# Altium schematic sheet Minion.SchDoc (part 3 of 4) (continued)
## Nets (continued)
U1_2.T28(CORE_VSS) U1_2.T30(CORE_VSS) U1_2.U1(CORE_VSS) U1_2.U3(CORE_VSS) U1_2.U5(CORE_VSS) U1_2.U7(CORE_VSS) U1_2.U9(CORE_VSS) U1_2.U11(CORE_VSS) U1_2.U13(CORE_VSS) U1_2.U15(CORE_VSS) U1_2.U17(CORE_VSS) U1_2.U19(CORE_VSS) U1_2.U21(CORE_VSS) U1_2.U23(CORE_VSS) U1_2.U25(CORE_VSS) U1_2.U27(CORE_VSS) U1_2.U29(CORE_VSS) U1_2.V2(CORE_VSS) U1_2.V4(CORE_VSS) U1_2.V6(CORE_VSS) U1_2.V8(CORE_VSS) U1_2.V10(CORE_VSS) U1_2.V12(CORE_VSS) U1_2.V14(CORE_VSS) U1_2.V16(CORE_VSS) U1_2.V18(CORE_VSS) U1_2.V20(CORE_VSS) U1_2.V22(CORE_VSS) U1_2.V24(CORE_VSS) U1_2.V26(CORE_VSS) U1_2.V28(CORE_VSS) U1_2.V30(CORE_VSS) U1_2.W1(CORE_VSS) U1_2.W3(CORE_VSS) U1_2.W5(CORE_VSS) U1_2.W7(CORE_VSS) U1_2.W9(CORE_VSS) U1_2.W11(CORE_VSS) U1_2.W13(CORE_VSS) U1_2.W15(CORE_VSS) U1_2.W17(CORE_VSS) U1_2.W19(CORE_VSS) U1_2.W21(CORE_VSS) U1_2.W23(CORE_VSS) U1_2.W25(CORE_VSS) U1_2.W27(CORE_VSS) U1_2.W29(CORE_VSS) U1_2.Y2(CORE_VSS) U1_2.Y4(CORE_VSS) U1_2.Y6(CORE_VSS) U1_2.Y8(CORE_VSS) U1_2.Y10(CORE_VSS) U1_2.Y12(CORE_VSS) U1_2.Y14(CORE_VSS) U1_2.Y16(CORE_VSS) U1_2.Y18(CORE_VSS) U1_2.Y20(CORE_VSS) U1_2.Y22(CORE_VSS) U1_2.Y24(CORE_VSS) U1_2.Y26(CORE_VSS) U1_2.Y28(CORE_VSS) U1_2.Y30(CORE_VSS) U1_3.A1(CORE_VSS) U1_3.A3(CORE_VSS) U1_3.A5(CORE_VSS) U1_3.A7(CORE_VSS) U1_3.A9(CORE_VSS) U1_3.A11(CORE_VSS) U1_3.A13(CORE_VSS) U1_3.A15(CORE_VSS) U1_3.A17(CORE_VSS) U1_3.A19(CORE_VSS) U1_3.A21(CORE_VSS) U1_3.A23(CORE_VSS) U1_3.A25(CORE_VSS) U1_3.A27(CORE_VSS) U1_3.A29(CORE_VSS) U1_3.AA1(CORE_VSS) U1_3.AA3(CORE_VSS) U1_3.AA5(CORE_VSS) U1_3.AA7(CORE_VSS) U1_3.AA9(CORE_VSS) U1_3.AA11(CORE_VSS) U1_3.AA13(CORE_VSS) U1_3.AA15(CORE_VSS) U1_3.AA17(CORE_VSS) U1_3.AA19(CORE_VSS) U1_3.AA21(CORE_VSS) U1_3.AA23(CORE_VSS) U1_3.AA25(CORE_VSS) U1_3.AA27(CORE_VSS) U1_3.AA29(CORE_VSS) U1_3.AB2(CORE_VSS) U1_3.AB4(CORE_VSS) U1_3.AB6(CORE_VSS) U1_3.AB8(CORE_VSS) U1_3.AB10(CORE_VSS) U1_3.AB12(CORE_VSS) U1_3.AB14(CORE_VSS) U1_3.AB16(CORE_VSS) U1_3.AB18(CORE_VSS) U1_3.AB20(CORE_VSS) U1_3.AB22(CORE_VSS) U1_3.AB24(CORE_VSS) U1_3.AB26(CORE_VSS) U1_3.AB28(CORE_VSS) U1_3.AB30(CORE_VSS) U1_3.AC1(CORE_VSS) U1_3.AC3(CORE_VSS) U1_3.AC5(CORE_VSS) U1_3.AC7(CORE_VSS) U1_3.AC9(CORE_VSS) U1_3.AC11(CORE_VSS) U1_3.AC13(CORE_VSS) U1_3.AC15(CORE_VSS) U1_3.AC17(CORE_VSS) U1_3.AC19(CORE_VSS) U1_3.AC21(CORE_VSS) U1_3.AC23(CORE_VSS) U1_3.AC25(CORE_VSS) U1_3.AC27(CORE_VSS) U1_3.AC29(CORE_VSS) U1_3.AD2(CORE_VSS) U1_3.AD4(CORE_VSS) U1_3.AD6(CORE_VSS) U1_3.AD8(CORE_VSS) U1_3.AD10(CORE_VSS) U1_3.AD12(CORE_VSS) U1_3.AD14(CORE_VSS) U1_3.AD16(CORE_VSS) U1_3.AD18(CORE_VSS) U1_3.AD20(CORE_VSS) U1_3.AD22(CORE_VSS) U1_3.AD24(CORE_VSS) U1_3.AD26(CORE_VSS) U1_3.AD28(CORE_VSS) U1_3.AD30(CORE_VSS) U1_3.AE1(CORE_VSS) U1_3.AE3(CORE_VSS) U1_3.AE5(CORE_VSS) U1_3.AE7(CORE_VSS) U1_3.AE9(CORE_VSS) U1_3.AE11(CORE_VSS) U1_3.AE13(CORE_VSS) U1_3.AE15(CORE_VSS) U1_3.AE17(CORE_VSS) U1_3.AE19(CORE_VSS) U1_3.AE21(CORE_VSS) U1_3.AE23(CORE_VSS) U1_3.AE25(CORE_VSS) U1_3.AE27(CORE_VSS) U1_3.AE29(CORE_VSS) U1_3.AF2(CORE_VSS) U1_3.AF4(CORE_VSS) U1_3.AF6(CORE_VSS) U1_3.AF8(CORE_VSS) U1_3.AF10(CORE_VSS) U1_3.AF12(CORE_VSS) U1_3.AF14(CORE_VSS) U1_3.AF16(CORE_VSS) U1_3.AF18(CORE_VSS) U1_3.AF20(CORE_VSS) U1_3.AF22(CORE_VSS) U1_3.AF24(CORE_VSS) U1_3.AF26(CORE_VSS) U1_3.AF28(CORE_VSS) U1_3.AF30(CORE_VSS) U1_3.AG1(CORE_VSS) U1_3.AG3(CORE_VSS) U1_3.AG5(CORE_VSS) U1_3.AG7(CORE_VSS) U1_3.AG9(CORE_VSS) U1_3.AG11(CORE_VSS) U1_3.AG13(CORE_VSS) U1_3.AG15(CORE_VSS) U1_3.AG17(CORE_VSS) U1_3.AG19(CORE_VSS) U1_3.AG21(CORE_VSS) U1_3.AG23(CORE_VSS) U1_3.AG25(CORE_VSS) U1_3.AG27(CORE_VSS) U1_3.AG29(CORE_VSS) U1_3.AH2(CORE_VSS) U1_3.AH4(CORE_VSS) U1_3.AH6(CORE_VSS) U1_3.AH8(CORE_VSS) U1_3.AH10(CORE_VSS) U1_3.AH12(CORE_VSS) U1_3.AH14(CORE_VSS) U1_3.AH16(CORE_VSS) U1_3.AH18(CORE_VSS) U1_3.AH20(CORE_VSS) U1_3.AH22(CORE_VSS) U1_3.AH24(CORE_VSS) U1_3.AH26(CORE_VSS) U1_3.AH28(CORE_VSS) U1_3.AH30(CORE_VSS) U1_3.AJ1(CORE_VSS) U1_3.AJ3(CORE_VSS) U1_3.AJ4(IO_VSS) U1_3.AJ6(IO_VSS) U1_3.AJ9(CORE_VSS) U1_3.AJ11(IO_VSS) U1_3.AJ17(CORE_VSS) U1_3.AJ20(CHIP_ADDR0) U1_3.AJ21(CHIP_ADDR2) U1_3.AJ22(CHIP_ADDR4) U1_3.AJ26(SPI_MODE) U1_3.AJ27(CORE_VSS) U1_3.AJ29(CORE_VSS) U1_3.AK2(CORE_VSS) U1_3.AK11(TD_AVSS18) U1_3.AK12(POR_AGND18) U1_3.AK14(CORE_VSS) U1_3.AK15(PLL_AVSS) U1_3.AK16(PLL_AVSS2) U1_3.AK17(IO_VSS) U1_3.AK20(CORE_VSS) U1_3.AK22(CHIP_ADDR3) U1_3.AK23(IO_VSS) U1_3.AK30(CORE_VSS) U1_3.B2(CORE_VSS) U1_3.B4(CORE_VSS) U1_3.B6(CORE_VSS) U1_3.B8(CORE_VSS) U1_3.B10(CORE_VSS) U1_3.B12(CORE_VSS) U1_3.B14(CORE_VSS) U1_3.B16(CORE_VSS) U1_3.B18(CORE_VSS) U1_3.B20(CORE_VSS) U1_3.B22(CORE_VSS) U1_3.B24(CORE_VSS) U1_3.B26(CORE_VSS) U1_3.B28(CORE_VSS) U1_3.B30(CORE_VSS) U1_3.C1(CORE_VSS) U1_3.C3(CORE_VSS) U1_3.C5(CORE_VSS) U1_3.C7(CORE_VSS) U1_3.C9(CORE_VSS) U1_3.C11(CORE_VSS) U1_3.C13(CORE_VSS) U1_3.C15(CORE_VSS) U1_3.C17(CORE_VSS) U1_3.C19(CORE_VSS) U1_3.C21(CORE_VSS) U1_3.C23(CORE_VSS) U1_3.C25(CORE_VSS) U1_3.C27(CORE_VSS) U1_3.C29(CORE_VSS) U1_3.D2(CORE_VSS) U1_3.D4(CORE_VSS) U1_3.D6(CORE_VSS) U1_3.D8(CORE_VSS) U1_3.D10(CORE_VSS) U1_3.D12(CORE_VSS) U1_3.D14(CORE_VSS) U1_3.D16(CORE_VSS) U1_3.D18(CORE_VSS) U1_3.D20(CORE_VSS) U1_3.D22(CORE_VSS) U1_3.D24(CORE_VSS) U1_3.D26(CORE_VSS) U1_3.D28(CORE_VSS) U1_3.D30(CORE_VSS) U1_3.E1(CORE_VSS) U1_3.E3(CORE_VSS) U1_3.E5(CORE_VSS) U1_3.E7(CORE_VSS) U1_3.E9(CORE_VSS) U1_3.E11(CORE_VSS) U1_3.E13(CORE_VSS) U1_3.E15(CORE_VSS) U1_3.E17(CORE_VSS) U1_3.E19(CORE_VSS) U1_3.E21(CORE_VSS) U1_3.E23(CORE_VSS) U1_3.E25(CORE_VSS) U1_3.E27(CORE_VSS) U1_3.E29(CORE_VSS) U1_3.F2(CORE_VSS) U1_3.F4(CORE_VSS) U1_3.F6(CORE_VSS) U1_3.F8(CORE_VSS) U1_3.F10(CORE_VSS) U1_3.F12(CORE_VSS) U1_3.F14(CORE_VSS) U1_3.F16(CORE_VSS) U1_3.F18(CORE_VSS) U1_3.F20(CORE_VSS) U1_3.F22(CORE_VSS) U1_3.F24(CORE_VSS) U1_3.F26(CORE_VSS) U1_3.F28(CORE_VSS) U1_3.F30(CORE_VSS) U1_3.G1(CORE_VSS) U1_3.G3(CORE_VSS) U1_3.G5(CORE_VSS) U1_3.G7(CORE_VSS) U1_3.G9(CORE_VSS) U1_3.G11(CORE_VSS) U1_3.G13(CORE_VSS) U1_3.G15(CORE_VSS) U1_3.G17(CORE_VSS) U1_3.G19(CORE_VSS) U1_3.G21(CORE_VSS) U1_3.G23(CORE_VSS) U1_3.G25(CORE_VSS) U1_3.G27(CORE_VSS) U1_3.G29(CORE_VSS) U1_3.H2(CORE_VSS) U1_3.H4(CORE_VSS) U1_3.H6(CORE_VSS) U1_3.H8(CORE_VSS) U1_3.H10(CORE_VSS) U1_3.H12(CORE_VSS) U1_3.H14(CORE_VSS) U1_3.H16(CORE_VSS) U1_3.H18(CORE_VSS) U1_3.H20(CORE_VSS) U1_3.H22(CORE_VSS) U1_3.H24(CORE_VSS) U1_3.H26(CORE_VSS) U1_3.H28(CORE_VSS) U1_3.H30(CORE_VSS) U1_3.J1(CORE_VSS) U1_3.J3(CORE_VSS) U1_3.J5(CORE_VSS) U1_3.J7(CORE_VSS) U1_3.J9(CORE_VSS) U1_3.J11(CORE_VSS) U1_3.J13(CORE_VSS) U1_3.J15(CORE_VSS) U1_3.J17(CORE_VSS) U1_3.J19(CORE_VSS) U1_3.J21(CORE_VSS) U1_3.J23(CORE_VSS) U1_3.J25(CORE_VSS) U1_3.J27(CORE_VSS) U1_3.J29(CORE_VSS) U1_3.K2(CORE_VSS) U1_3.K4(CORE_VSS) U1_3.K6(CORE_VSS) U1_3.K8(CORE_VSS) U1_3.K10(CORE_VSS) U1_3.K12(CORE_VSS) U1_3.K14(CORE_VSS) U1_3.K16(CORE_VSS) U1_3.K18(CORE_VSS) U1_3.K20(CORE_VSS) U1_3.K22(CORE_VSS) U1_3.K24(CORE_VSS) U1_3.K26(CORE_VSS) U1_3.K28(CORE_VSS) U1_3.K30(CORE_VSS) U1_3.L1(CORE_VSS) U1_3.L3(CORE_VSS) U1_3.L5(CORE_VSS) U1_3.L7(CORE_VSS) U1_3.L9(CORE_VSS) U1_3.L11(CORE_VSS) U1_3.L13(CORE_VSS) U1_3.L15(CORE_VSS) U1_3.L17(CORE_VSS) U1_3.L19(CORE_VSS) U1_3.L21(CORE_VSS) U1_3.L23(CORE_VSS) U1_3.L25(CORE_VSS) U1_3.L27(CORE_VSS) U1_3.L29(CORE_VSS) U1_3.M2(CORE_VSS) U1_3.M4(CORE_VSS) U1_3.M6(CORE_VSS) U1_3.M8(CORE_VSS) U1_3.M10(CORE_VSS) U1_3.M12(CORE_VSS) U1_3.M14(CORE_VSS) U1_3.M16(CORE_VSS) U1_3.M18(CORE_VSS) U1_3.M20(CORE_VSS) U1_3.M22(CORE_VSS) U1_3.M24(CORE_VSS) U1_3.M26(CORE_VSS) U1_3.M28(CORE_VSS) U1_3.M30(CORE_VSS) U1_3.N1(CORE_VSS) U1_3.N3(CORE_VSS) U1_3.N5(CORE_VSS) U1_3.N7(CORE_VSS) U1_3.N9(CORE_VSS) U1_3.N11(CORE_VSS) U1_3.N13(CORE_VSS) U1_3.N15(CORE_VSS) U1_3.N17(CORE_VSS) U1_3.N19(CORE_VSS) U1_3.N21(CORE_VSS) U1_3.N23(CORE_VSS) U1_3.N25(CORE_VSS) U1_3.N27(CORE_VSS) U1_3.N29(CORE_VSS) U1_3.P2(CORE_VSS) U1_3.P4(CORE_VSS) U1_3.P6(CORE_VSS) U1_3.P8(CORE_VSS) U1_3.P10(CORE_VSS) U1_3.P12(CORE_VSS) U1_3.P14(CORE_VSS) U1_3.P16(CORE_VSS) U1_3.P18(CORE_VSS) U1_3.P20(CORE_VSS) U1_3.P22(CORE_VSS) U1_3.P24(CORE_VSS) U1_3.P26(CORE_VSS) U1_3.P28(CORE_VSS) U1_3.P30(CORE_VSS) U1_3.R1(CORE_VSS) U1_3.R3(CORE_VSS) U1_3.R5(CORE_VSS) U1_3.R7(CORE_VSS) U1_3.R9(CORE_VSS) U1_3.R11(CORE_VSS) U1_3.R13(CORE_VSS) U1_3.R15(CORE_VSS) U1_3.R17(CORE_VSS) U1_3.R19(CORE_VSS) U1_3.R21(CORE_VSS) U1_3.R23(CORE_VSS) U1_3.R25(CORE_VSS) U1_3.R27(CORE_VSS) U1_3.R29(CORE_VSS) U1_3.T2(CORE_VSS) U1_3.T4(CORE_VSS) U1_3.T6(CORE_VSS) U1_3.T8(CORE_VSS) U1_3.T10(CORE_VSS) U1_3.T12(CORE_VSS) U1_3.T14(CORE_VSS) U1_3.T16(CORE_VSS) U1_3.T18(CORE_VSS) U1_3.T20(CORE_VSS) U1_3.T22(CORE_VSS) U1_3.T24(CORE_VSS) U1_3.T26(CORE_VSS) U1_3.T28(CORE_VSS) U1_3.T30(CORE_VSS) U1_3.U1(CORE_VSS) U1_3.U3(CORE_VSS) U1_3.U5(CORE_VSS) U1_3.U7(CORE_VSS) U1_3.U9(CORE_VSS) U1_3.U11(CORE_VSS) U1_3.U13(CORE_VSS) U1_3.U15(CORE_VSS) U1_3.U17(CORE_VSS) U1_3.U19(CORE_VSS) U1_3.U21(CORE_VSS) U1_3.U23(CORE_VSS) U1_3.U25(CORE_VSS) U1_3.U27(CORE_VSS) U1_3.U29(CORE_VSS) U1_3.V2(CORE_VSS) U1_3.V4(CORE_VSS) U1_3.V6(CORE_VSS) U1_3.V8(CORE_VSS) U1_3.V10(CORE_VSS) U1_3.V12(CORE_VSS) U1_3.V14(CORE_VSS) U1_3.V16(CORE_VSS) U1_3.V18(CORE_VSS) U1_3.V20(CORE_VSS) U1_3.V22(CORE_VSS) U1_3.V24(CORE_VSS) U1_3.V26(CORE_VSS) U1_3.V28(CORE_VSS) U1_3.V30(CORE_VSS) U1_3.W1(CORE_VSS) U1_3.W3(CORE_VSS) U1_3.W5(CORE_VSS) U1_3.W7(CORE_VSS) U1_3.W9(CORE_VSS) U1_3.W11(CORE_VSS) U1_3.W13(CORE_VSS) U1_3.W15(CORE_VSS) U1_3.W17(CORE_VSS) U1_3.W19(CORE_VSS) U1_3.W21(CORE_VSS) U1_3.W23(CORE_VSS) U1_3.W25(CORE_VSS) U1_3.W27(CORE_VSS) U1_3.W29(CORE_VSS) U1_3.Y2(CORE_VSS) U1_3.Y4(CORE_VSS) U1_3.Y6(CORE_VSS) U1_3.Y8(CORE_VSS) U1_3.Y10(CORE_VSS) U1_3.Y12(CORE_VSS) U1_3.Y14(CORE_VSS) U1_3.Y16(CORE_VSS) U1_3.Y18(CORE_VSS) U1_3.Y20(CORE_VSS) U1_3.Y22(CORE_VSS) U1_3.Y24(CORE_VSS) U1_3.Y26(CORE_VSS) U1_3.Y28(CORE_VSS) U1_3.Y30(CORE_VSS) U1_4.A1(CORE_VSS) U1_4.A3(CORE_VSS) U1_4.A5(CORE_VSS) U1_4.A7(CORE_VSS) U1_4.A9(CORE_VSS) U1_4.A11(CORE_VSS) U1_4.A13(CORE_VSS) U1_4.A15(CORE_VSS) U1_4.A17(CORE_VSS) U1_4.A19(CORE_VSS) U1_4.A21(CORE_VSS) U1_4.A23(CORE_VSS) U1_4.A25(CORE_VSS) U1_4.A27(CORE_VSS) U1_4.A29(CORE_VSS) U1_4.AA1(CORE_VSS) U1_4.AA3(CORE_VSS) U1_4.AA5(CORE_VSS) U1_4.AA7(CORE_VSS) U1_4.AA9(CORE_VSS) U1_4.AA11(CORE_VSS) U1_4.AA13(CORE_VSS) U1_4.AA15(CORE_VSS) U1_4.AA17(CORE_VSS) U1_4.AA19(CORE_VSS) U1_4.AA21(CORE_VSS) U1_4.AA23(CORE_VSS) U1_4.AA25(CORE_VSS) U1_4.AA27(CORE_VSS) U1_4.AA29(CORE_VSS) U1_4.AB2(CORE_VSS) U1_4.AB4(CORE_VSS) U1_4.AB6(CORE_VSS) U1_4.AB8(CORE_VSS) U1_4.AB10(CORE_VSS) U1_4.AB12(CORE_VSS) U1_4.AB14(CORE_VSS) U1_4.AB16(CORE_VSS) U1_4.AB18(CORE_VSS) U1_4.AB20(CORE_VSS) U1_4.AB22(CORE_VSS) U1_4.AB24(CORE_VSS) U1_4.AB26(CORE_VSS) U1_4.AB28(CORE_VSS) U1_4.AB30(CORE_VSS) U1_4.AC1(CORE_VSS) U1_4.AC3(CORE_VSS) U1_4.AC5(CORE_VSS) U1_4.AC7(CORE_VSS) U1_4.AC9(CORE_VSS) U1_4.AC11(CORE_VSS) U1_4.AC13(CORE_VSS) U1_4.AC15(CORE_VSS) U1_4.AC17(CORE_VSS) U1_4.AC19(CORE_VSS) U1_4.AC21(CORE_VSS) U1_4.AC23(CORE_VSS) U1_4.AC25(CORE_VSS) U1_4.AC27(CORE_VSS) U1_4.AC29(CORE_VSS) U1_4.AD2(CORE_VSS) U1_4.AD4(CORE_VSS) U1_4.AD6(CORE_VSS) U1_4.AD8(CORE_VSS) U1_4.AD10(CORE_VSS) U1_4.AD12(CORE_VSS) U1_4.AD14(CORE_VSS) U1_4.AD16(CORE_VSS) U1_4.AD18(CORE_VSS) U1_4.AD20(CORE_VSS) U1_4.AD22(CORE_VSS) U1_4.AD24(CORE_VSS) U1_4.AD26(CORE_VSS) U1_4.AD28(CORE_VSS) U1_4.AD30(CORE_VSS) U1_4.AE1(CORE_VSS) U1_4.AE3(CORE_VSS) U1_4.AE5(CORE_VSS) U1_4.AE7(CORE_VSS) U1_4.AE9(CORE_VSS) U1_4.AE11(CORE_VSS) U1_4.AE13(CORE_VSS) U1_4.AE15(CORE_VSS) U1_4.AE17(CORE_VSS) U1_4.AE19(CORE_VSS) U1_4.AE21(CORE_VSS) U1_4.AE23(CORE_VSS) U1_4.AE25(CORE_VSS) U1_4.AE27(CORE_VSS) U1_4.AE29(CORE_VSS) U1_4.AF2(CORE_VSS) U1_4.AF4(CORE_VSS) U1_4.AF6(CORE_VSS) U1_4.AF8(CORE_VSS) U1_4.AF10(CORE_VSS) U1_4.AF12(CORE_VSS) U1_4.AF14(CORE_VSS) U1_4.AF16(CORE_VSS) U1_4.AF18(CORE_VSS) U1_4.AF20(CORE_VSS) U1_4.AF22(CORE_VSS) U1_4.AF24(CORE_VSS) U1_4.AF26(CORE_VSS) U1_4.AF28(CORE_VSS) U1_4.AF30(CORE_VSS) U1_4.AG1(CORE_VSS) U1_4.AG3(CORE_VSS) U1_4.AG5(CORE_VSS) U1_4.AG7(CORE_VSS) U1_4.AG9(CORE_VSS) U1_4.AG11(CORE_VSS) U1_4.AG13(CORE_VSS) U1_4.AG15(CORE_VSS) U1_4.AG17(CORE_VSS) U1_4.AG19(CORE_VSS) U1_4.AG21(CORE_VSS) U1_4.AG23(CORE_VSS) U1_4.AG25(CORE_VSS) U1_4.AG27(CORE_VSS) U1_4.AG29(CORE_VSS) U1_4.AH2(CORE_VSS) U1_4.AH4(CORE_VSS) U1_4.AH6(CORE_VSS) U1_4.AH8(CORE_VSS) U1_4.AH10(CORE_VSS) U1_4.AH12(CORE_VSS) U1_4.AH14(CORE_VSS) U1_4.AH16(CORE_VSS) U1_4.AH18(CORE_VSS) U1_4.AH20(CORE_VSS) U1_4.AH22(CORE_VSS) U1_4.AH24(CORE_VSS) U1_4.AH26(CORE_VSS) U1_4.AH28(CORE_VSS) U1_4.AH30(CORE_VSS) U1_4.AJ1(CORE_VSS) U1_4.AJ3(CORE_VSS) U1_4.AJ4(IO_VSS) U1_4.AJ6(IO_VSS) U1_4.AJ9(CORE_VSS) U1_4.AJ11(IO_VSS) U1_4.AJ17(CORE_VSS) U1_4.AJ21(CHIP_ADDR2) U1_4.AJ22(CHIP_ADDR4) U1_4.AJ26(SPI_MODE) U1_4.AJ27(CORE_VSS) U1_4.AJ29(CORE_VSS) U1_4.AK2(CORE_VSS) U1_4.AK11(TD_AVSS18) U1_4.AK12(POR_AGND18) U1_4.AK14(CORE_VSS) U1_4.AK15(PLL_AVSS) U1_4.AK16(PLL_AVSS2) U1_4.AK17(IO_VSS) U1_4.AK20(CORE_VSS) U1_4.AK22(CHIP_ADDR3) U1_4.AK23(IO_VSS) U1_4.AK30(CORE_VSS) U1_4.B2(CORE_VSS) U1_4.B4(CORE_VSS) U1_4.B6(CORE_VSS) U1_4.B8(CORE_VSS) U1_4.B10(CORE_VSS) U1_4.B12(CORE_VSS) U1_4.B14(CORE_VSS) U1_4.B16(CORE_VSS) U1_4.B18(CORE_VSS) U1_4.B20(CORE_VSS) U1_4.B22(CORE_VSS) U1_4.B24(CORE_VSS) U1_4.B26(CORE_VSS) U1_4.B28(CORE_VSS) U1_4.B30(CORE_VSS) U1_4.C1(CORE_VSS) U1_4.C3(CORE_VSS) U1_4.C5(CORE_VSS) U1_4.C7(CORE_VSS) U1_4.C9(CORE_VSS) U1_4.C11(CORE_VSS) U1_4.C13(CORE_VSS) U1_4.C15(CORE_VSS) U1_4.C17(CORE_VSS) U1_4.C19(CORE_VSS) U1_4.C21(CORE_VSS) U1_4.C23(CORE_VSS) U1_4.C25(CORE_VSS) U1_4.C27(CORE_VSS) U1_4.C29(CORE_VSS) U1_4.D2(CORE_VSS) U1_4.D4(CORE_VSS) U1_4.D6(CORE_VSS) U1_4.D8(CORE_VSS) U1_4.D10(CORE_VSS) U1_4.D12(CORE_VSS) U1_4.D14(CORE_VSS) U1_4.D16(CORE_VSS) U1_4.D18(CORE_VSS) U1_4.D20(CORE_VSS) U1_4.D22(CORE_VSS) U1_4.D24(CORE_VSS) U1_4.D26(CORE_VSS) U1_4.D28(CORE_VSS) U1_4.D30(CORE_VSS) U1_4.E1(CORE_VSS) U1_4.E3(CORE_VSS) U1_4.E5(CORE_VSS) U1_4.E7(CORE_VSS) U1_4.E9(CORE_VSS) U1_4.E11(CORE_VSS) U1_4.E13(CORE_VSS) U1_4.E15(CORE_VSS) U1_4.E17(CORE_VSS) U1_4.E19(CORE_VSS) U1_4.E21(CORE_VSS) U1_4.E23(CORE_VSS) U1_4.E25(CORE_VSS) U1_4.E27(CORE_VSS) U1_4.E29(CORE_VSS) U1_4.F2(CORE_VSS) U1_4.F4(CORE_VSS) U1_4.F6(CORE_VSS) U1_4.F8(CORE_VSS) U1_4.F10(CORE_VSS) U1_4.F12(CORE_VSS) U1_4.F14(CORE_VSS) U1_4.F16(CORE_VSS) U1_4.F18(CORE_VSS) U1_4.F20(CORE_VSS) U1_4.F22(CORE_VSS) U1_4.F24(CORE_VSS) U1_4.F26(CORE_VSS) U1_4.F28(CORE_VSS) U1_4.F30(CORE_VSS) U1_4.G1(CORE_VSS) U1_4.G3(CORE_VSS) U1_4.G5(CORE_VSS) U1_4.G7(CORE_VSS) U1_4.G9(CORE_VSS) U1_4.G11(CORE_VSS) U1_4.G13(CORE_VSS) U1_4.G15(CORE_VSS) U1_4.G17(CORE_VSS) U1_4.G19(CORE_VSS) U1_4.G21(CORE_VSS) U1_4.G23(CORE_VSS) U1_4.G25(CORE_VSS) U1_4.G27(CORE_VSS) U1_4.G29(CORE_VSS) U1_4.H2(CORE_VSS) U1_4.H4(CORE_VSS) U1_4.H6(CORE_VSS) U1_4.H8(CORE_VSS) U1_4.H10(CORE_VSS) U1_4.H12(CORE_VSS) U1_4.H14(CORE_VSS) U1_4.H16(CORE_VSS) U1_4.H18(CORE_VSS) U1_4.H20(CORE_VSS) U1_4.H22(CORE_VSS) U1_4.H24(CORE_VSS) U1_4.H26(CORE_VSS) U1_4.H28(CORE_VSS) U1_4.H30(CORE_VSS) U1_4.J1(CORE_VSS) U1_4.J3(CORE_VSS) U1_4.J5(CORE_VSS) U1_4.J7(CORE_VSS) U1_4.J9(CORE_VSS) U1_4.J11(CORE_VSS) U1_4.J13(CORE_VSS) U1_4.J15(CORE_VSS) U1_4.J17(CORE_VSS) U1_4.J19(CORE_VSS) U1_4.J21(CORE_VSS) U1_4.J23(CORE_VSS) U1_4.J25(CORE_VSS) U1_4.J27(CORE_VSS) U1_4.J29(CORE_VSS) U1_4.K2(CORE_VSS) U1_4.K4(CORE_VSS) U1_4.K6(CORE_VSS) U1_4.K8(CORE_VSS) U1_4.K10(CORE_VSS) U1_4.K12(CORE_VSS) U1_4.K14(CORE_VSS) U1_4.K16(CORE_VSS) U1_4.K18(CORE_VSS) U1_4.K20(CORE_VSS) U1_4.K22(CORE_VSS) U1_4.K24(CORE_VSS) U1_4.K26(CORE_VSS) U1_4.K28(CORE_VSS) U1_4.K30(CORE_VSS) U1_4.L1(CORE_VSS) U1_4.L3(CORE_VSS) U1_4.L5(CORE_VSS) U1_4.L7(CORE_VSS) U1_4.L9(CORE_VSS) U1_4.L11(CORE_VSS) U1_4.L13(CORE_VSS) U1_4.L15(CORE_VSS) U1_4.L17(CORE_VSS) U1_4.L19(CORE_VSS) U1_4.L21(CORE_VSS) U1_4.L23(CORE_VSS) U1_4.L25(CORE_VSS) U1_4.L27(CORE_VSS) U1_4.L29(CORE_VSS) U1_4.M2(CORE_VSS) U1_4.M4(CORE_VSS) U1_4.M6(CORE_VSS) U1_4.M8(CORE_VSS) U1_4.M10(CORE_VSS) U1_4.M12(CORE_VSS) U1_4.M14(CORE_VSS) U1_4.M16(CORE_VSS) U1_4.M18(CORE_VSS) U1_4.M20(CORE_VSS) U1_4.M22(CORE_VSS) U1_4.M24(CORE_VSS) U1_4.M26(CORE_VSS) U1_4.M28(CORE_VSS) U1_4.M30(CORE_VSS) U1_4.N1(CORE_VSS) U1_4.N3(CORE_VSS) U1_4.N5(CORE_VSS) U1_4.N7(CORE_VSS) U1_4.N9(CORE_VSS) U1_4.N11(CORE_VSS) U1_4.N13(CORE_VSS) U1_4.N15(CORE_VSS) U1_4.N17(CORE_VSS) U1_4.N19(CORE_VSS) U1_4.N21(CORE_VSS) U1_4.N23(CORE_VSS) U1_4.N25(CORE_VSS) U1_4.N27(CORE_VSS) U1_4.N29(CORE_VSS) U1_4.P2(CORE_VSS) U1_4.P4(CORE_VSS) U1_4.P6(CORE_VSS) U1_4.P8(CORE_VSS) U1_4.P10(CORE_VSS) U1_4.P12(CORE_VSS) U1_4.P14(CORE_VSS) U1_4.P16(CORE_VSS) U1_4.P18(CORE_VSS) U1_4.P20(CORE_VSS) U1_4.P22(CORE_VSS) U1_4.P24(CORE_VSS) U1_4.P26(CORE_VSS) U1_4.P28(CORE_VSS) U1_4.P30(CORE_VSS) U1_4.R1(CORE_VSS) U1_4.R3(CORE_VSS) U1_4.R5(CORE_VSS) U1_4.R7(CORE_VSS) U1_4.R9(CORE_VSS) U1_4.R11(CORE_VSS) U1_4.R13(CORE_VSS) U1_4.R15(CORE_VSS) U1_4.R17(CORE_VSS) U1_4.R19(CORE_VSS) U1_4.R21(CORE_VSS) U1_4.R23(CORE_VSS) U1_4.R25(CORE_VSS) U1_4.R27(CORE_VSS) U1_4.R29(CORE_VSS) U1_4.T2(CORE_VSS) U1_4.T4(CORE_VSS) U1_4.T6(CORE_VSS) U1_4.T8(CORE_VSS) U1_4.T10(CORE_VSS) U1_4.T12(CORE_VSS) U1_4.T14(CORE_VSS) U1_4.T16(CORE_VSS) U1_4.T18(CORE_VSS) U1_4.T20(CORE_VSS) U1_4.T22(CORE_VSS) U1_4.T24(CORE_VSS) U1_4.T26(CORE_VSS) U1_4.T28(CORE_VSS) U1_4.T30(CORE_VSS) U1_4.U1(CORE_VSS) U1_4.U3(CORE_VSS) U1_4.U5(CORE_VSS) U1_4.U7(CORE_VSS) U1_4.U9(CORE_VSS) U1_4.U11(CORE_VSS) U1_4.U13(CORE_VSS) U1_4.U15(CORE_VSS) U1_4.U17(CORE_VSS) U1_4.U19(CORE_VSS) U1_4.U21(CORE_VSS) U1_4.U23(CORE_VSS) U1_4.U25(CORE_VSS) U1_4.U27(CORE_VSS) U1_4.U29(CORE_VSS) U1_4.V2(CORE_VSS) U1_4.V4(CORE_VSS) U1_4.V6(CORE_VSS) U1_4.V8(CORE_VSS) U1_4.V10(CORE_VSS) U1_4.V12(CORE_VSS) U1_4.V14(CORE_VSS) U1_4.V16(CORE_VSS) U1_4.V18(CORE_VSS) U1_4.V20(CORE_VSS) U1_4.V22(CORE_VSS) U1_4.V24(CORE_VSS) U1_4.V26(CORE_VSS) U1_4.V28(CORE_VSS) U1_4.V30(CORE_VSS) U1_4.W1(CORE_VSS) U1_4.W3(CORE_VSS) U1_4.W5(CORE_VSS) U1_4.W7(CORE_VSS) U1_4.W9(CORE_VSS) U1_4.W11(CORE_VSS) U1_4.W13(CORE_VSS) U1_4.W15(CORE_VSS) U1_4.W17(CORE_VSS) U1_4.W19(CORE_VSS) U1_4.W21(CORE_VSS) U1_4.W23(CORE_VSS) U1_4.W25(CORE_VSS) U1_4.W27(CORE_VSS) U1_4.W29(CORE_VSS) U1_4.Y2(CORE_VSS) U1_4.Y4(CORE_VSS) U1_4.Y6(CORE_VSS) U1_4.Y8(CORE_VSS) U1_4.Y10(CORE_VSS) U1_4.Y12(CORE_VSS) U1_4.Y14(CORE_VSS) U1_4.Y16(CORE_VSS) U1_4.Y18(CORE_VSS) U1_4.Y20(CORE_VSS) U1_4.Y22(CORE_VSS) U1_4.Y24(CORE_VSS) U1_4.Y26(CORE_VSS) U1_4.Y28(CORE_VSS) U1_4.Y30(CORE_VSS) U1P_1.4(GND) U1P_1.9(EP) U1P_2.4(GND) U1P_2.9(EP) U1P_3.4(GND) U1P_3.9(EP) U1P_4.4(GND) U1P_4.9(EP) U1P_5.4(GND) U1P_5.9(EP) U1P_6.4(GND) U1P_6.9(EP) U1P_7.4(GND) U1P_7.9(EP) U1P_8.4(GND) U1P_8.9(EP) U2.2(GND) U2.3(GND) U2.4(N.C.) U2.5(N.C.) U2.6(GND) U2.7(GND) U3.2(GND) U4.2(GND) U5.2(GND) U6.6(GND) U6.7(GND) U7.6(GND) U7.7(GND) U8.6(GND) U8.7(GND) U9.6(GND) U9.7(GND) YO1_1.2(GND) YO1_2.2(GND) YO1_3.2(GND) YO1_4.2(GND) YO3_1.2(GND) YO3_2.2(GND) YO3_3.2(GND) YO3_4.2(GND) YO4_1.2(GND) YO4_2.2(GND) YO4_3.2(GND) YO4_4.2(GND) YO5_1.2(GND) YO5_2.2(GND) YO5_3.2(GND) YO5_4.2(GND)
0.9V: C26.1 R29.2 R31.2 U1_1.AJ16(PLL_AVDD2) U1_2.AJ16(PLL_AVDD2) U1_3.AJ16(PLL_AVDD2) U1_4.AJ16(PLL_AVDD2)
1.8V: C25.2 R29.1 U1_1.AJ12(TD_AVDD18) U1_1.AJ15(PLL_AVDD) U1_1.AK13(POR_AVDD18) U1_2.AJ12(TD_AVDD18) U1_2.AJ15(PLL_AVDD) U1_2.AK13(POR_AVDD18) U1_3.AJ12(TD_AVDD18) U1_3.AJ15(PLL_AVDD) U1_3.AK13(POR_AVDD18) U1_4.AJ12(TD_AVDD18) U1_4.AJ15(PLL_AVDD) U1_4.AK13(POR_AVDD18) U6.1(OUTPUT)
3.3V: C4.1 C8.1 C9.1 C10.1 C11.1 C16.1 C17.1 CO1_1.1 CO1_2.1 CO1_3.1 CO1_4.1 CO2_1.1 CO2_2.1 CO2_3.1 CO2_4.1 CO3_1.1 CO3_2.1 CO3_3.1 CO3_4.1 CO4_1.1 CO4_2.1 CO4_3.1 CO4_4.1 CO7_1.1 CO7_2.1 CO7_3.1 CO7_4.1 J1.2 R17.1 R22.2 R27.1 RO2_1.2 RO2_2.2 RO2_3.2 RO2_4.2 RO3_1.2 RO3_2.2 RO3_3.2 RO3_4.2 U1.10(VDD) U1.19(AVDD) U1.26(VDD) U1.35(VUSB3V3) U1.38(VDD) U1.57(VDD) U1_1.AJ19(IO_VDD) U1_1.AJ23(IO_VDD) U1_1.AK4(IO_VDD) U1_1.AK6(IO_VDD) U1_1.AK10(IO_VDD) U1_2.AJ19(IO_VDD) U1_2.AJ20(CHIP_ADDR0) U1_2.AJ23(IO_VDD) U1_2.AK4(IO_VDD) U1_2.AK6(IO_VDD) U1_2.AK10(IO_VDD) U1_3.AJ19(IO_VDD) U1_3.AJ23(IO_VDD) U1_3.AK4(IO_VDD) U1_3.AK6(IO_VDD) U1_3.AK10(IO_VDD) U1_3.AK21(CHIP_ADDR1) U1_4.AJ19(IO_VDD) U1_4.AJ20(CHIP_ADDR0) U1_4.AJ23(IO_VDD) U1_4.AK4(IO_VDD) U1_4.AK6(IO_VDD) U1_4.AK10(IO_VDD) U1_4.AK21(CHIP_ADDR1) U3.4(NC) U3.5(Vout) U7.1(OUTPUT) U8.1(OUTPUT) U9.1(OUTPUT) YO1_1.1(OE) YO1_1.4(VDD) YO1_2.1(OE) YO1_2.4(VDD) YO1_3.1(OE) YO1_3.4(VDD) YO1_4.1(OE) YO1_4.4(VDD) YO3_1.1(OE) YO3_1.4(VDD) YO3_2.1(OE) YO3_2.4(VDD) YO3_3.1(OE) YO3_3.4(VDD) YO3_4.1(OE) YO3_4.4(VDD) YO4_1.1(OE) YO4_1.4(VDD) YO4_2.1(OE) YO4_2.4(VDD) YO4_3.1(OE) YO4_3.4(VDD) YO4_4.1(OE) YO4_4.4(VDD) YO5_1.1(OE) YO5_1.4(VDD) YO5_2.1(OE) YO5_2.4(VDD) YO5_3.1(OE) YO5_3.4(VDD) YO5_4.1(OE) YO5_4.4(VDD)
5.0V: C1P_1.2 C1P_2.2 C1P_3.2 C1P_4.2 C1P_5.2 C1P_6.2 C1P_7.2 C1P_8.2 C14.1 D1P_1.1(A1) D1P_1.2(A2) D1P_2.1(A1) D1P_2.2(A2) D1P_3.1(A1) D1P_3.2(A2) D1P_4.1(A1) D1P_4.2(A2) D1P_5.1(A1) D1P_5.2(A2) D1P_6.1(A1) D1P_6.2(A2) D1P_7.1(A1) D1P_7.2(A2) D1P_8.1(A1) D1P_8.2(A2) D7.1(C) D8.2(A) R26.1 U1P_1.7(VCC) U1P_2.7(VCC) U1P_3.7(VCC) U1P_4.7(VCC) U1P_5.7(VCC) U1P_6.7(VCC) U1P_7.7(VCC) U1P_8.7(VCC) U2.1(OUTPUT) U4.3(Vin) U5.3(Vin)
12V: C4P_1.1 C4P_2.1 C4P_3.1 C4P_4.1 C4P_5.1 C4P_6.1 C4P_7.1 C4P_8.1 C5P_1.1 C5P_2.1 C5P_3.1 C5P_4.1 C5P_5.1 C5P_6.1 C5P_7.1 C5P_8.1 C9P_1.1 C9P_2.1 C9P_3.1 C9P_4.1 C9P_5.1 C9P_6.1 C9P_7.1 C9P_8.1 C10P_1.1 C10P_2.1 C10P_3.1 C10P_4.1 C10P_5.1 C10P_6.1 C10P_7.1 C10P_8.1 C11P_1.1 C11P_2.1 C11P_3.1 C11P_4.1 C11P_5.1 C11P_6.1 C11P_7.1 C11P_8.1 C12P_1.1 C12P_2.1 C12P_3.1 C12P_4.1 C12P_5.1 C12P_6.1 C12P_7.1 C12P_8.1 D6.1(C) D9.2(A) D10.1(C) D11.1(C) D12.1(C) J4.2 J4.4 J4.6 J9.2 J9.4 J9.6 J10.2 J10.4 J10.6 J12.3 J13.3 J14.3 J15.3 Q1P_1.5(D) Q1P_1.6(D) Q1P_1.7(D) Q1P_1.8(D) Q1P_2.5(D) Q1P_2.6(D) Q1P_2.7(D) Q1P_2.8(D) Q1P_3.5(D) Q1P_3.6(D) Q1P_3.7(D) Q1P_3.8(D) Q1P_4.5(D) Q1P_4.6(D) Q1P_4.7(D) Q1P_4.8(D) Q1P_5.5(D) Q1P_5.6(D) Q1P_5.7(D) Q1P_5.8(D) Q1P_6.5(D) Q1P_6.6(D) Q1P_6.7(D) Q1P_6.8(D) Q1P_7.5(D) Q1P_7.6(D) Q1P_7.7(D) Q1P_7.8(D) Q1P_8.5(D) Q1P_8.6(D) Q1P_8.7(D) Q1P_8.8(D) R15.1 R28.2
BOOT1: C3P_1.1 D1P_1.3(CC) U1P_1.8(BOOT)
BOOT2: C3P_2.1 D1P_2.3(CC) U1P_2.8(BOOT)
BOOT3: C3P_3.1 D1P_3.3(CC) U1P_3.8(BOOT)
BOOT4: C3P_4.1 D1P_4.3(CC) U1P_4.8(BOOT)
BOOT5: C3P_5.1 D1P_5.3(CC) U1P_5.8(BOOT)
BOOT6: C3P_6.1 D1P_6.3(CC) U1P_6.8(BOOT)
BOOT7: C3P_7.1 D1P_7.3(CC) U1P_7.8(BOOT)
BOOT8: C3P_8.1 D1P_8.3(CC) U1P_8.8(BOOT)
CompFB+: U1.11(AN5/C1IN1+/VBUSON/VBUSST/RPI37/RB5)
CompFB-: U1.12(AN4/C1IN2-/USBOEN/RPI36/RB4)
CSN4: U1.14(AN2/C2IN2-/VMIO/RPI34/RB2)
CSP4: U1.13(AN3/C2IN1+/VPIO/RPI35/RB3)
D+: D5.1(C1) J2.3 U1.37(D+/RG2)
D-: D5.3(C2) J2.2 U1.36(D-/RG3)
DRVLogic: C2P_1.1 C2P_2.1 C2P_3.1 C2P_4.1 C2P_5.1 C2P_6.1 C2P_7.1 C2P_8.1 R17.2 U1.42(RTCC/DMLN/RPI72/RD8) U1P_1.6(Vlogic) U1P_2.6(Vlogic) U1P_3.6(Vlogic) U1P_4.6(Vlogic) U1P_5.6(Vlogic) U1P_6.6(Vlogic) U1P_7.6(Vlogic) U1P_8.6(Vlogic)
FB: C3.1 R18.1 U1.17(PGEC1/AN6/RPI38/RB6)
GREEN: D2.2(A) U1.47(PGED2/SOSCI/C3IN3-/RPI61/RC13)
HO1: Q1P_1.4(G) U1P_1.1(HO)
HO2: Q1P_2.4(G) U1P_2.1(HO)
HO3: Q1P_3.4(G) U1P_3.1(HO)
HO4: Q1P_4.4(G) U1P_4.1(HO)
HO5: Q1P_5.4(G) U1P_5.1(HO)
HO6: Q1P_6.4(G) U1P_6.1(HO)
HO7: Q1P_7.4(G) U1P_7.1(HO)
HO8: Q1P_8.4(G) U1P_8.1(HO)
INT_OUT1: DI4_1.2(A) U1_1.AK24(INT_OUT)
INT_OUT2: DI4_2.2(A) U1_2.AK24(INT_OUT)
INT_OUT3: DI4_3.2(A) U1_3.AK24(INT_OUT)
INT_OUT4: DI4_4.2(A) U1_4.AK24(INT_OUT)
LDO3.3V-5.0V: R27.2 R30.1 U6.5(N.C.) U6.8(INPUT)
LDO5.0V: C15.1 D7.2(A) D8.1(C) R25.1 R26.2 R30.2 U3.1(Vin) U3.3(STBY) U7.5(N.C.) U7.8(INPUT) U8.5(N.C.) U8.8(INPUT) U9.5(N.C.) U9.8(INPUT)
LED_BUSY1: DI5_1.2(A) U1_1.AK8(LED_BUSY)
LED_BUSY2: DI5_2.2(A) U1_2.AK8(LED_BUSY)
LED_BUSY3: DI5_3.2(A) U1_3.AK8(LED_BUSY)
LED_BUSY4: DI5_4.2(A) U1_4.AK8(LED_BUSY)
LED_CLK1: DI7_1.2(A) U1_1.AK5(LED_CLK)
LED_CLK2: DI7_2.2(A) U1_2.AK5(LED_CLK)
LED_CLK3: DI7_3.2(A) U1_3.AK5(LED_CLK)
LED_CLK4: DI7_4.2(A) U1_4.AK5(LED_CLK)
LED_HOT1: DI3_1.2(A) U1_1.AJ7(LED_HOT)
LED_HOT2: DI3_2.2(A) U1_2.AJ7(LED_HOT)
LED_HOT3: DI3_3.2(A) U1_3.AJ7(LED_HOT)
LED_HOT4: DI3_4.2(A) U1_4.AJ7(LED_HOT)
LED_IDLE1: DI1_1.2(A) U1_1.AJ8(LED_IDLE)
LED_IDLE2: DI1_2.2(A) U1_2.AJ8(LED_IDLE)
LED_IDLE3: DI1_3.2(A) U1_3.AJ8(LED_IDLE)
LED_IDLE4: DI1_4.2(A) U1_4.AJ8(LED_IDLE)
LED_NONCE1: DI8_1.2(A) U1_1.AK7(LED_NONCE)
LED_NONCE2: DI8_2.2(A) U1_2.AK7(LED_NONCE)
LED_NONCE3: DI8_3.2(A) U1_3.AK7(LED_NONCE)
LED_NONCE4: DI8_4.2(A) U1_4.AK7(LED_NONCE)
LED_POWER1: DI6_1.2(A) U1_1.AK9(LED_POWER)
LED_POWER2: DI6_2.2(A) U1_2.AK9(LED_POWER)
LED_POWER3: DI6_3.2(A) U1_3.AK9(LED_POWER)
LED_POWER4: DI6_4.2(A) U1_4.AK9(LED_POWER)
LED_SPI1: DI2_1.2(A) U1_1.AJ5(LED_SPI)
LED_SPI2: DI2_2.2(A) U1_2.AJ5(LED_SPI)
LED_SPI3: DI2_3.2(A) U1_3.AJ5(LED_SPI)
LED_SPI4: DI2_4.2(A) U1_4.AJ5(LED_SPI)
LM12V: D9.1(C) R28.1 U2.8(INPUT) U4.1(Vout) U5.1(Vout)
LO1: Q2P_1.4(G) Q3P_1.4(G) U1P_1.3(LO)
LO2: Q2P_2.4(G) Q3P_2.4(G) U1P_2.3(LO)
LO3: Q2P_3.4(G) Q3P_3.4(G) U1P_3.3(LO)
LO4: Q2P_4.4(G) Q3P_4.4(G) U1P_4.3(LO)
LO5: Q2P_5.4(G) Q3P_5.4(G) U1P_5.3(LO)
LO6: Q2P_6.4(G) Q3P_6.4(G) U1P_6.3(LO)
LO7: Q2P_7.4(G) Q3P_7.4(G) U1P_7.3(LO)
LO8: Q2P_8.4(G) Q3P_8.4(G) U1P_8.3(LO)
Main OSC In: C12.1 U1.39(OSC1/RPI60/RC12) Y1.1
Main OSC Out: C13.1 U1.40(OSC2/CLKO/RC15) Y1.2
MCLR: C7.1 J1.1 R22.1 U1.7(MCLR)
MCU5.0V: R23.2 U1.34(VBUS)
MEAS12: C2.1 R15.2 R16.2 U1.18(PGED1/AN7/RCV/RPI39/RB7)
ORANGE: D4.2(A) U1.45(PMCS1/RPI75/RD11)
PGC: J1.5 U1.15(PGEC3/AN1/VREF-/RPI33/RB1)
PGD: J1.4 U1.16(PGED3/AN0/VREF+/RPI32/RB0)
POR_IOVSEL1: RI1_1.1 U1_1.AJ13(POR_IOVSEL)
POR_IOVSEL2: RI1_2.1 U1_2.AJ13(POR_IOVSEL)
POR_IOVSEL3: RI1_3.1 U1_3.AJ13(POR_IOVSEL)
POR_IOVSEL4: RI1_4.1 U1_4.AJ13(POR_IOVSEL)
PWM1: J12.1
PWM1H: R1.1 U1.61(AN25/PWM1H/PMD1/RPI81/RE1) U1P_6.5(IN)
PWM1L: R2.1 U1.60(AN24/PWM1L/PMD0/RP80/RE0) U1P_5.5(IN)
PWM2: J13.1
PWM2H: R10.1 U1.63(AN27/PWM2H/PMD3/RPI83/RE3) U1P_8.5(IN)
PWM2L: R11.1 U1.62(AN26/PWM2L/PMD2/RP82/RE2) U1P_7.5(IN)
PWM3: J14.1
PWM3H: R12.2 U1.1(AN29/PWM3H/PMD5/RP85/RE5) U1P_2.5(IN)
PWM3L: R9.1 U1.64(AN28/PWM3L/PMD4/RP84/RE4) U1P_1.5(IN)
PWM4: J15.1
PWM4H: R4.2 U1.3(AN31/PWM4H/PMD7/RP87/RE7) U1P_4.5(IN)
PWM4L: R3.2 U1.2(AN30/PWM4L/PMD6/RPI86/RE6) U1P_3.5(IN)
RED: D1.2(A) U1.48(PGEC2/SOSCO/C3IN1-/T1CK/RPI62/RC14)
REPORT_N: U1.51(PMBE/RP67/RD3)
REPORT_P: U1.50(DPH/RP66/RD2)
RESET_ASIC: CO8_1.1 CO8_2.1 CO8_3.1 CO8_4.1 RO3_1.1 RO3_2.1 RO3_3.1 RO3_4.1 U1.43(ASDA1/DPLN/RPI73/RD9) U1_1.AK28(RSTN_IN) U1_2.AK28(RSTN_IN) U1_3.AK28(RSTN_IN) U1_4.AK28(RSTN_IN)
RPMF1: J12.2
RPMF2: J13.2
RPMF3: J14.2
RPMF4: J15.2
SPI_CS: U1.8(C2IN1-/PMA2/RPI121/RG9) U1_1.AJ25(SPI_CSN) U1_2.AJ25(SPI_CSN) U1_3.AJ25(SPI_CSN) U1_4.AJ25(SPI_CSN)
SPI_MISO: U1.5(C1IN1-/SDI2/PMA4/RPI119/RG7) U1_1.AJ24(SPI_MISO) U1_2.AJ24(SPI_MISO) U1_3.AJ24(SPI_MISO) U1_4.AJ24(SPI_MISO)
SPI_MOSI: U1.6(C2IN3-/SDO2/PMA3/RP120/RG8) U1_1.AK25(SPI_MOSI) U1_2.AK25(SPI_MOSI) U1_3.AK25(SPI_MOSI) U1_4.AK25(SPI_MOSI)
SPI_SCK: U1.4(C1IN3-/SCK2/PMA5/RP118/RG6) U1_1.AK27(SPI_CLK) U1_2.AK27(SPI_CLK) U1_3.AK27(SPI_CLK) U1_4.AK27(SPI_CLK)
SWN1: C3P_1.2 L1P_1.1 Q1P_1.1(S) Q1P_1.2(S) Q1P_1.3(S) Q2P_1.5(D) Q2P_1.6(D) Q2P_1.7(D) Q2P_1.8(D) Q3P_1.5(D) Q3P_1.6(D) Q3P_1.7(D) Q3P_1.8(D) U1P_1.2(SW)
SWN2: C3P_2.2 L1P_2.1 Q1P_2.1(S) Q1P_2.2(S) Q1P_2.3(S) Q2P_2.5(D) Q2P_2.6(D) Q2P_2.7(D) Q2P_2.8(D) Q3P_2.5(D) Q3P_2.6(D) Q3P_2.7(D) Q3P_2.8(D) U1P_2.2(SW)
SWN3: C3P_3.2 L1P_3.1 Q1P_3.1(S) Q1P_3.2(S) Q1P_3.3(S) Q2P_3.5(D) Q2P_3.6(D) Q2P_3.7(D) Q2P_3.8(D) Q3P_3.5(D) Q3P_3.6(D) Q3P_3.7(D) Q3P_3.8(D) U1P_3.2(SW)
SWN4: C3P_4.2 L1P_4.1 Q1P_4.1(S) Q1P_4.2(S) Q1P_4.3(S) Q2P_4.5(D) Q2P_4.6(D) Q2P_4.7(D) Q2P_4.8(D) Q3P_4.5(D) Q3P_4.6(D) Q3P_4.7(D) Q3P_4.8(D) U1P_4.2(SW)
SWN5: C3P_5.2 L1P_5.1 Q1P_5.1(S) Q1P_5.2(S) Q1P_5.3(S) Q2P_5.5(D) Q2P_5.6(D) Q2P_5.7(D) Q2P_5.8(D) Q3P_5.5(D) Q3P_5.6(D) Q3P_5.7(D) Q3P_5.8(D) U1P_5.2(SW)
SWN6: C3P_6.2 L1P_6.1 Q1P_6.1(S) Q1P_6.2(S) Q1P_6.3(S) Q2P_6.5(D) Q2P_6.6(D) Q2P_6.7(D) Q2P_6.8(D) Q3P_6.5(D) Q3P_6.6(D) Q3P_6.7(D) Q3P_6.8(D) U1P_6.2(SW)
SWN7: C3P_7.2 L1P_7.1 Q1P_7.1(S) Q1P_7.2(S) Q1P_7.3(S) Q2P_7.5(D) Q2P_7.6(D) Q2P_7.7(D) Q2P_7.8(D) Q3P_7.5(D) Q3P_7.6(D) Q3P_7.7(D) Q3P_7.8(D) U1P_7.2(SW)
SWN8: C3P_8.2 L1P_8.1 Q1P_8.1(S) Q1P_8.2(S) Q1P_8.3(S) Q2P_8.5(D) Q2P_8.6(D) Q2P_8.7(D) Q2P_8.8(D) Q3P_8.5(D) Q3P_8.6(D) Q3P_8.7(D) Q3P_8.8(D) U1P_8.2(SW)
TEST_MODE1: RI2_1.1 U1_1.AK3(TEST_MODE)
TEST_MODE2: RI2_2.1 U1_2.AK3(TEST_MODE)
TEST_MODE3: RI2_3.1 U1_3.AK3(TEST_MODE)
TEST_MODE4: RI2_4.1 U1_4.AK3(TEST_MODE)
TP8: U1.33(USBID/RP99/RF3)
TP9: U1.30(AN15/PMA0/RPI47/RB15)
TP10: U1.29(AN14/PMA1/RPI46/RB14)
TP11: U1.28(TDI/AN13/PMA10/RPI45/RB13)
TP12: U1.27(TCK/AN12/PMA11/RPI44/RB12)
TP13: U1.24(TDO/AN11/PMA12/RPI43/RB11)
TP14: U1.23(TMS/AN10/CVREF/PMA13/RPI42/RB10)
TP15: U1.22(AN9/PMA7//RPI41/RB9)
TP16: U1.21(AN8/PMA6/RPI40/RB8)
U2Rx: U1.31(SDA2/PMA9/RP100/RF4)
U2Tx: U1.32(SCL2/PMA8/RP101/RF5)
USB5.0V: D5.4(C3) D5.6(C4) J2.1 R23.1 R25.2
VCAP: C1.1 U1.56(VCAP)
XCLK: QO1_1.1(B) QO1_2.1(B) QO1_3.1(B) QO1_4.1(B) RO1_1.1 RO1_2.1 RO1_3.1 RO1_4.1 U1.55(C3IN1+/VCMPST3/RP71/RD7)
XCLK1: CO6_1.1 QO1_1.3(C) RO1_1.2 RO2_1.1 U1_1.AK19(XTAL12M_IN) YO1_1.3(OSC) YO2_1.2 YO3_1.3(OSC) YO4_1.3(OSC) YO5_1.3(OSC)
XCLK2: CO6_2.1 QO1_2.3(C) RO1_2.2 RO2_2.1 U1_2.AK19(XTAL12M_IN) YO1_2.3(OSC) YO2_2.2 YO3_2.3(OSC) YO4_2.3(OSC) YO5_2.3(OSC)
XCLK3: CO6_3.1 QO1_3.3(C) RO1_3.2 RO2_3.1 U1_3.AK19(XTAL12M_IN) YO1_3.3(OSC) YO2_3.2 YO3_3.3(OSC) YO4_3.3(OSC) YO5_3.3(OSC)
XCLK4: CO6_4.1 QO1_4.3(C) RO1_4.2 RO2_4.1 U1_4.AK19(XTAL12M_IN) YO1_4.3(OSC) YO2_4.2 YO3_4.3(OSC) YO4_4.3(OSC) YO5_4.3(OSC)
XCLK_OUT1: CO5_1.1 DI9_1.2(A) U1_1.AK18(XTAL12M_OUT) YO2_1.1
XCLK_OUT2: CO5_2.1 DI9_2.2(A) U1_2.AK18(XTAL12M_OUT) YO2_2.1
XCLK_OUT3: CO5_3.1 DI9_3.2(A) U1_3.AK18(XTAL12M_OUT) YO2_3.1
XCLK_OUT4: CO5_4.1 DI9_4.2(A) U1_4.AK18(XTAL12M_OUT) YO2_4.1
XCLK_TP1: U1.46(INT0/DMH/RP64/RD0)
XCLK_TP2: U1.49(VCPCON/RP65/RD1)
XCLK_TP3: U1.52(PMWR/RP68/RD4)
XCLK_TP4: U1.53(PMRD/RP69/RD5)
XCLK_TP5: U1.54(C3IN2-/RP70/RD6)
XCLK_TP6: U1.58(VCMPST1/RP96/RF0)
XCLK_TP7: U1.59(VCMPST2/RP97/RF1)
YELLOW: D3.2(A) U1.44(ASCL1/PMCS2/RPI74/RD10)

Not connected (* = marked no-connect by the designer): J2 4; U6 2(GND) 3(GND) 4(N.C.); U7 2(GND) 3(GND) 4(N.C.); U8 2(GND) 3(GND) 4(N.C.); U9 2(GND) 3(GND) 4(N.C.)